# Altium schematic sheet FPGA_Config.SchDoc
size 420 x 297 mm
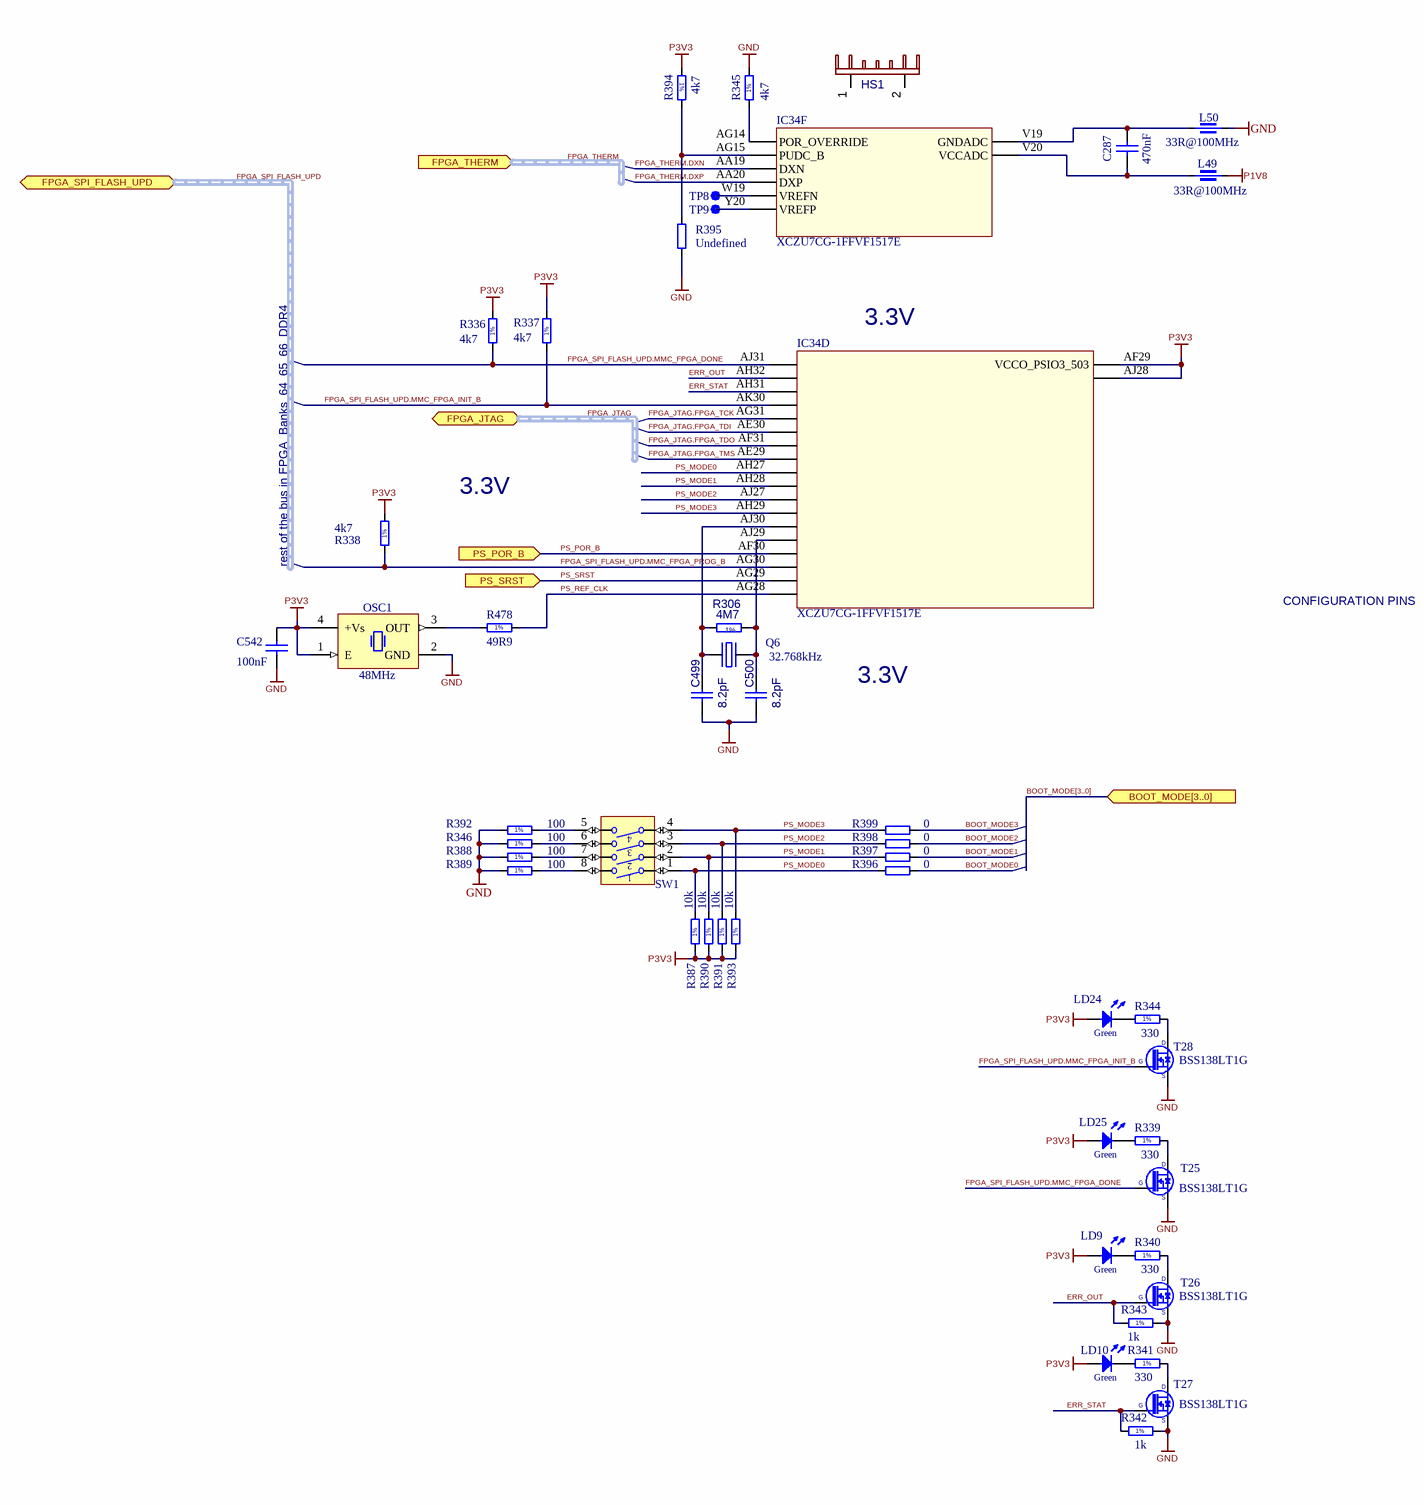
[diagram p0: FPGA_Config.SchDoc]

## Parts
C287  470nF  [CAPC0603X33N]
C499  value 8.2pF  [CAPC1005X55N]  (hidden comment: Capacitor - non polarized CAPC1005X55N)
C500  value 8.2pF  [CAPC1005X55N]  (hidden comment: Capacitor - non polarized CAPC1005X55N)
C542  100nF  [CAPC0603X33N]
HS1  HSINK_AAVID_342947  [HS_AAVID_342947]  (value not drawn)
IC34  XCZU7CG-1FFVF1517E  (parts D,F of 26)
L49  33R@100MHz  [INDC1005X55N]
L50  33R@100MHz  [INDC1005X55N]
LD9  Green  [LED_KINGBRIGHT_KPH-1608CGCK]
LD10  Green  [LED_KINGBRIGHT_KPH-1608CGCK]
LD24  Green  [LED_AVAGO_HSME-C120]
LD25  Green  [LED_AVAGO_HSME-C120]
OSC1  48MHz  [OSC_IQD_CFPS-39]
Q6  32.768kHz  [XTAL_ABRACON_ABS06]
R306  value 4M7  (hidden comment: Resistor - 1% RESC1005X40N)
R336  4k7  [RESC1005X40N]
R337  4k7  [RESC1005X40N]
R338  4k7  [RESC1005X40N]
R339  330  [RESC1005X40N]
R340  330  [RESC1005X40N]
R341  330  [RESC1005X40N]
R342  1k  [RESC1005X40N]
R343  1k  [RESC1005X40N]
R344  330  [RESC1005X40N]
R345  4k7  [RESC1005X40N]
R346  100  [RESC1005X40N]
R387  10k  [RESC1005X40N]
R388  100  [RESC1005X40N]
R389  100  [RESC1005X40N]
R390  10k  [RESC1005X40N]
R391  10k  [RESC1005X40N]
R392  100  [RESC1005X40N]
R393  10k  [RESC1005X40N]
R394  4k7  [RESC1005X40N]
R395  Undefined  [RESC1005X40N]
R396  0  [RESC1005X40N]
R397  0  [RESC1005X40N]
R398  0  [RESC1005X40N]
R399  0  [RESC1005X40N]
R478  49R9  [RESC1005X40N]
SW1  Switch  [SW_TYCO_1571983-4]  (value not drawn)
T25  BSS138LT1G  [SOT95P240X110-3N]
T26  BSS138LT1G  [SOT95P240X110-3N]
T27  BSS138LT1G  [SOT95P240X110-3N]
T28  BSS138LT1G  [SOT95P240X110-3N]
TP8  SMD Pad  [C100]  (value not drawn)
TP9  SMD Pad  [C100]  (value not drawn)

## Ports
BOOT_MODE[3..0] (in), FPGA_JTAG (bidir, harness FPGA_JTAG), FPGA_SPI_FLASH_UPD (bidir, harness FPGA_SPI_FLASH_UPD), FPGA_THERM (in, harness FPGA_THERM), PS_POR_B (in), PS_SRST (in)

## Nets
GND: C499.1 C500.1 C542.2 L50.1 OSC1.2(GND) R342.2 R343.2 R345.2 R346.1 R388.1 R389.1 R392.1 R395.1 T25.2(S) T26.2(S) T27.2(S) T28.2(S)
P1V8: L49.1
P3V3: C542.1 IC34.AF29(VCCO_PSIO3_503) IC34.AJ28(VCCO_PSIO3_503_1) LD9.2(A) LD10.2(A) LD24.2(A) LD25.2(A) OSC1.1(E) OSC1.4(+Vs) R336.2 R337.2 R338.2 R387.1 R390.1 R391.1 R393.1 R394.1
BOOT_MODE0: R396.2
BOOT_MODE1: R397.2
BOOT_MODE2: R398.2
BOOT_MODE3: R399.2
ERR_OUT: IC34.AH32(PS8_X0Y0_1) R343.1 T26.1(G)
ERR_STAT: IC34.AH31(PS8_X0Y0_2) R342.1 T27.1(G)
FPGA_JTAG.FPGA_TCK: IC34.AG31(PS8_X0Y0_4)
FPGA_JTAG.FPGA_TDI: IC34.AE30(PS8_X0Y0_5)
FPGA_JTAG.FPGA_TDO: IC34.AF31(PS8_X0Y0_6)
FPGA_JTAG.FPGA_TMS: IC34.AE29(PS8_X0Y0_7)
FPGA_SPI_FLASH_UPD.MMC_FPGA_DONE: IC34.AJ31(PS8_X0Y0) R336.1 T25.1(G)
FPGA_SPI_FLASH_UPD.MMC_FPGA_INIT_B: IC34.AK30(PS8_X0Y0_3) R337.1 T28.1(G)
FPGA_SPI_FLASH_UPD.MMC_FPGA_PROG_B: IC34.AG30(PS8_X0Y0_15) R338.1
FPGA_THERM.DXN: IC34.AA19(DXN)
FPGA_THERM.DXP: IC34.AA20(DXP)
PS_MODE0: IC34.AH27(PS8_X0Y0_8) R387.2 R396.1 SW1.1
PS_MODE1: IC34.AH28(PS8_X0Y0_9) R390.2 R397.1 SW1.2
PS_MODE2: IC34.AJ27(PS8_X0Y0_10) R391.2 R398.1 SW1.3
PS_MODE3: IC34.AH29(PS8_X0Y0_11) R393.2 R399.1 SW1.4
PS_POR_B: IC34.AF30(PS8_X0Y0_14) ; port PS_POR_B
PS_REF_CLK: IC34.AG28(PS8_X0Y0_17) R478.2
PS_SRST: IC34.AG29(PS8_X0Y0_16) ; port PS_SRST
NetC287_1: C287.1 IC34.V19(GNDADC) L50.2
NetC287_2: C287.2 IC34.V20(VCCADC) L49.2
NetC499_2: C499.2 IC34.AJ30(PS8_X0Y0_12) Q6.2(OSC2) R306.1
NetC500_2: C500.2 IC34.AJ29(PS8_X0Y0_13) Q6.1(OSC1) R306.2
NetIC34_AG14: IC34.AG14(POR_OVERRIDE) R345.1
NetIC34_AG15: IC34.AG15(PUDC_B) R394.2 R395.2
NetIC34_W19: IC34.W19(VREFN) TP8.1
NetIC34_Y20: IC34.Y20(VREFP) TP9.1
NetLD9_1: LD9.1(C) R340.1
NetLD10_1: LD10.1(C) R341.1
NetLD24_1: LD24.1(C) R344.1
NetLD25_1: LD25.1(C) R339.1
NetOSC1_3: OSC1.3(OUT) R478.1
NetR339_2: R339.2 T25.3(D)
NetR340_2: R340.2 T26.3(D)
NetR341_2: R341.2 T27.3(D)
NetR344_2: R344.2 T28.3(D)
NetR346_2: R346.2 SW1.6
NetR388_2: R388.2 SW1.7
NetR389_2: R389.2 SW1.8
NetR392_2: R392.2 SW1.5

Not connected (* = marked no-connect by the designer): HS1 1(MOUNT1) 2(MOUNT2)

## Buses and harness runs
bus BOOT_MODE[3..0] = port BOOT_MODE[3..0]
harness FPGA_JTAG = port FPGA_JTAG
harness FPGA_SPI_FLASH_UPD = port FPGA_SPI_FLASH_UPD
harness FPGA_THERM = port FPGA_THERM

## Notes on the sheet
- (near IC34) 3.3V
- 3.3V
- rest of the bus in FPGA_Banks_64_65_66_DDR4
- CONFIGURATION PINS
- Project/Equipment
- Document
- Designer
- Drawn by
- Check.by
- Copyright WUT ISE 2020.
  This documentation describes Open Hardware and is licensed under the CERN OHL v.1.2. You may redistribute and modify this documentation under the terms of the CERN OHL v.1.2. (http://ohwr.org/CERNOHL). This documentation is distributed WITHOUT ANY EXPRESS OR IMPLIED WARRANTY, INCLUDING OF MERCHANTABILITY, SATISFACTORY QUALITY AND FITNESS FOR A PARTICULAR PURPOSE. Please see the CERN OHL v.1.2 for applicable conditions.
- Contact
- File
- Last Mod.
- Print Date
- Sheet
- Size
- A3
- of
- Rev
- (in symbol R306) 1%
- (in symbol R0402_1K_1%_0.0625W_100PPM) 1%
- (in symbol R0402_4K7_1%_0.0625W_100PPM) 1%
- (in symbol R0402_10K_1%_0.0625W_100PPM) 1%
- (in symbol R0402_49R9_1%_0.0625W_100PPM) 1%
- (in symbol R0402_100R_1%_0.1W_100PPM) 1%
- (in symbol R0402_330R_1%_0.0625W_100PPM) 1%

## Library data of the parts
C287 = CC0201_470NF_4V_20%_X5R: Non-polarised capacitor; Manufacturer: GENERIC; Manufacturer1 Part Number: AMK063BJ474MP-F; Part Description: SMD Multilayer Chip Ceramic Capacitor; TC: X5R; Tolerance: ±20%; Voltage: 4V; Author: CERN DEM JLC; Case: 0201; Component Kind: Standard; Component Type: Standard; CreateDate: 27/05/2010; HelpURL: \\cern.ch\dfs\Applications\Altium\Datasheets\CC0201_X5R_TAIYO-YUDEN_STANDARD-CLASS2.pdf; LatestRevisionDate: 27/05/2010; Manufacturer Part Number: CC0201_470NF_4V_20%_X5R; Manufacturer1 ComponentHeight: 0.33mm; Manufacturer1 Example: TAIYO YUDEN; Mounted: Yes; Part Number: CC0201_470NF_4V_20%_X5R; Pin Count: 2; SMD: Yes; Socket: No; Status: Not Recommended; Value: 470nF; Sense: No
C499 = CAPC1005X55N: Capacitor - non polarized CAPC1005X55N 8.2pF; Manufacturer Part Number: CC0402_8.2PF_50V_0.5PF_C0G; Manufacturer: GENERIC; Part Description: SMD Multilayer Chip Ceramic Capacitor; CmpIndex: 286; DXDB_LIBNAME: Capacitors SMD; Ref Designator: C499; SymIndex: 331; Tolerance: ±0.5pF; Cell Name: CAPC1005X55N; Part Name: Capacitor - non polarized CAPC1005X55N; Part Number: Capacitor - non polarized CAPC1005X55N; Orientation: 1 = 1
C500 = CAPC1005X55N: Capacitor - non polarized CAPC1005X55N 8.2pF; Manufacturer Part Number: CC0402_8.2PF_50V_0.5PF_C0G; Manufacturer: GENERIC; Part Description: SMD Multilayer Chip Ceramic Capacitor; CmpIndex: 619; DXDB_LIBNAME: Capacitors SMD; Ref Designator: C500; SymIndex: 331; Tolerance: ±0.5pF; Cell Name: CAPC1005X55N; Part Name: Capacitor - non polarized CAPC1005X55N; Part Number: Capacitor - non polarized CAPC1005X55N; Orientation: 1 = 1
C542 = CC0201_100NF_6.3V_10%_X5R: Non-polarised capacitor; Manufacturer: GENERIC; Manufacturer1 Part Number: 02016D104KAT2A; Part Description: SMD Multilayer Chip Ceramic Capacitor; TC: X5R; Tolerance: ±10%; Voltage: 6.3V; Author: CERN DEM JLC; Case: 0201; Component Kind: Standard; Component Type: Standard; CreateDate: 03/12/2007; HelpURL: \\cern.ch\dfs\Applications\Altium\Datasheets\CC0201_X5R_AVX.pdf; LatestRevisionDate: 03/12/2007; Manufacturer Part Number: CC0201_100NF_6.3V_10%_X5R; Manufacturer1 ComponentHeight: 0.33mm; Manufacturer1 Example: AVX; Mounted: Yes; Part Number: CC0201_100NF_6.3V_10%_X5R; Pin Count: 2; SMD: Yes; Socket: No; Status: Not Recommended; Value: 100nF; Sense: No
HS1 = HS_AAVID_342947: HSINK_AAVID_342947   1.9K/W; Manufacturer Part Number: 342947; Manufacturer: Aavid Thermalloy; Part Description: COPPER HEATSINK 57.9X59X11MM; CmpIndex: 21; DXDB_LIBNAME: MISC_GK; Ref Designator: HS1; SymIndex: 1784; Cell Name: HS_AAVID_342947; Part Name: HSINK_AAVID_342947; Part Number: HSINK_AAVID_342947; Value: 1.9K/W; Orientation: 0 = 0
L49 L50 = IND0402_MURATA_BLM15PX330SN1D: Manufacturer: MURATA; Part Description: SMD EMIFIL Chip Ferrite Bead; Tolerance: ±25%; Power: 3A; Resistance: 0.022R; Manufacturer Part Number: BLM15PX330SN1D; Part Number: IND0402_MURATA_BLM15PX330SN1D; Value: 33R@100MHz; Component Kind: Standard; Component Type: Standard; Pin Count: 2; Status: None; Case: 0402; Mounted: Yes; Socket: No; SMD: Yes; Sense: No; ComponentHeight: 0.55mm; HelpURL: \\cern.ch\dfs\Applications\Altium\Datasheets\IND0402_MURATA_BLM15PX.pdf; Author: CERN DEM JMW; CreateDate: 19/02/2014; LatestRevisionDate: 25/10/2018
LD9 LD10 = LED_KINGBRIGHT_KPH-1608CGCK: LED Green 1C 2A; Part Description: SMD Green LED, Case 1.6mmX0.8mm(0603), 0.65mm Thickness; PressFit: No; Bonding: No; Manufacturer Part Number: KPH-1608CGCK; Manufacturer: KINGBRIGHT; PackageDescription: SMT Green LED, Case 0603, Body L 1.6 x W 0.8mm H 0.65mm; Part Number: LED_KINGBRIGHT_KPH-1608CGCK; Component Kind: Standard; Component Type: Standard; Color: Green; Pin Count: 2; Mounted: Yes; Socket: No; SMD: Yes; Sense: No; ComponentHeight: 0.65mm; HelpURL: \\cern.ch\dfs\Applications\Altium\Datasheets\LED_KINGBRIGHT_KPH-1608CGCK.pdf; Author: CERN DEM JLC; CreateDate: 03.07.2017; LatestRevisionDate: 03.07.2017
LD24 LD25 = LED_AVAGO_HSME-C120: LED Green 1C 2A; Manufacturer: AVAGO TECHNOLOGIES; Part Description: High Performance Right Angle Chip Green LED; PressFit: No; Bonding: No; Manufacturer Part Number: HSME-C120; PackageDescription: Green Chip LED, 2-Leads, Body 1.7x1.1mm, Side Emitting Package; Part Number: LED_AVAGO_HSME-C120; Component Kind: Standard; Component Type: Standard; Color: Green; Pin Count: 2; Mounted: Yes; Socket: No; SMD: Yes; Sense: No; ComponentHeight: 0.7mm; HelpURL: \\cern.ch\dfs\Applications\Altium\Datasheets\LED_AVAGO_HSME-C120.pdf; ComponentLink1URL: \\cern.ch\dfs\Applications\Altium\Datasheets\LED_AVAGO_HSME-C110_DESIGN-GUIDE.pdf; ComponentLink1Description: Design Guide; Author: CERN DEM JMW; CreateDate: 22.07.2009; LatestRevisionDate: 20.06.2012
OSC1 = OSC_48MHZ_IQD_LFSPXO025166: Oscillator 4 pins 1=E 2=GND 3=OUT 4=+Vs; Manufacturer: IQD FREQUENCY PRODUCTS; Part Description: 3.3V, ±50ppm, 15pF, -40..85°C, CMOS Surface Mount Clock Oscillator (CFPS-39 Series); PressFit: No; Bonding: No; Manufacturer Part Number: LFSPXO025166; PackageDescription: Oscillator, Corner Concave, 2.20mm Pitch, 4 Pins, 2.70mm L X 3.40mm W X 1.20mm H, CFPS-39 Series; Part Number: OSC_48MHZ_IQD_LFSPXO025166; Value: 48MHz; Component Kind: Standard; Component Type: Standard; Pin Count: 4; Mounted: Yes; Socket: No; SMD: Yes; Sense: No; ComponentHeight: 1.2mm; HelpURL: \\cern.ch\dfs\Applications\Altium\Datasheets\OSC_IQD_LFSPXO025166.pdf; Author: CERN DEM JLC; CreateDate: 23.03.2011; LatestRevisionDate: 03.11.2016
Q6 = XTAL_32.768KHZ_ABRACON_ABS06-32.768KHZ-9: Quartz Crystal; Part Description: Tolerance: ±20ppm, -40°C to +85°C, 9pF, SMD Low Profile Crystal, ABS06 Series; PressFit: No; Bonding: No; Manufacturer Part Number: ABS06-32.768kHz-9; Manufacturer: ABRACON; PackageDescription: 2 Pins, 2.15x1.3mm, SMD Low Profile Crystal, ABS06 Series; Part Number: XTAL_32.768KHZ_ABRACON_ABS06-32.768KHZ-9; Value: 32.768kHz; Component Kind: Standard; Component Type: Standard; Pin Count: 2; Mounted: Yes; Socket: No; SMD: Yes; Sense: No; ComponentHeight: 0.6mm; HelpURL: \\cern.ch\dfs\Applications\Altium\Datasheets\XTAL_ABRACON_ABS06.pdf; Author: CERN DEM JMW; CreateDate: 12/08/2015; LatestRevisionDate: 12/08/2015
R306 = (no symbol name): Resistor - 1% RESC1005X40N 4M7; Manufacturer Part Number: R0402_4M7_1%_0.0625W_100PPM; Manufacturer: GENERIC; Part Description: General Purpose Thick Film Chip Resistor; CmpIndex: 616; DXDB_LIBNAME: Resistors SMD; Ref Designator: R306; SymIndex: 317; Cell Name: RESC1005X40N; Part Name: Resistor - 1% RESC1005X40N; Part Number: Resistor - 1% RESC1005X40N; Tolerance: ±1%; Orientation: 0 = 0
R336-R338 R345 R394 = R0402_4K7_1%_0.0625W_100PPM: Resistor - 1%; Manufacturer: GENERIC; Part Description: General Purpose Thick Film Chip Resistor; Manufacturer1 Part Number: 232270674702L; TC: ±100ppm/°C; PressFit: No; Manufacturer Part Number: R0402_4K7_1%_0.0625W_100PPM; Part Number: R0402_4K7_1%_0.0625W_100PPM; Tolerance: ±1%; Value: 4k7; Component Kind: Standard; Component Type: Standard; Pin Count: 2; Status: Not Recommended; Power: 0.0625W; Case: 0402; Mounted: Yes; Sense: No; Socket: No; SMD: Yes; Manufacturer1 Example: YAGEO PHYCOMP; Manufacturer1 ComponentHeight: 0.4mm; HelpURL: \\cern.ch\dfs\Applications\Altium\Datasheets\R0402_Phycomp_RC0402.pdf; Author: CERN DEM JLC; CreateDate: 03/12/2007; LatestRevisionDate: 17/10/2012
R339-R341 R344 = R0402_330R_1%_0.0625W_100PPM: Resistor - 1%; Manufacturer: GENERIC; Part Description: General Purpose Thick Film Chip Resistor; Manufacturer1 Part Number: 232270673301L; TC: ±100ppm/°C; PressFit: No; Manufacturer Part Number: R0402_330R_1%_0.0625W_100PPM; Part Number: R0402_330R_1%_0.0625W_100PPM; Tolerance: ±1%; Value: 330; Component Kind: Standard; Component Type: Standard; Pin Count: 2; Status: Not Recommended; Power: 0.0625W; Case: 0402; Mounted: Yes; Sense: No; Socket: No; SMD: Yes; Manufacturer1 Example: YAGEO PHYCOMP; Manufacturer1 ComponentHeight: 0.4mm; HelpURL: \\cern.ch\dfs\Applications\Altium\Datasheets\R0402_Phycomp_RC0402.pdf; Author: CERN DEM JLC; CreateDate: 03/12/2007; LatestRevisionDate: 17/10/2012
R342 R343 = R0402_1K_1%_0.0625W_100PPM: Resistor - 1%; Manufacturer: GENERIC; Part Description: General Purpose Thick Film Chip Resistor; Manufacturer1 Part Number: 232270671002L; TC: ±100ppm/°C; PressFit: No; Manufacturer Part Number: R0402_1K_1%_0.0625W_100PPM; Part Number: R0402_1K_1%_0.0625W_100PPM; Tolerance: ±1%; Value: 1k; Component Kind: Standard; Component Type: Standard; Pin Count: 2; Status: Not Recommended; Power: 0.0625W; Case: 0402; Mounted: Yes; Sense: No; Socket: No; SMD: Yes; Manufacturer1 Example: YAGEO PHYCOMP; Manufacturer1 ComponentHeight: 0.4mm; HelpURL: \\cern.ch\dfs\Applications\Altium\Datasheets\R0402_Phycomp_RC0402.pdf; Author: CERN DEM JLC; CreateDate: 03/12/2007; LatestRevisionDate: 17/10/2012
R346 R388 R389 R392 = R0402_100R_1%_0.1W_100PPM: Resistor - 1%; Manufacturer Part Number: R0402_100R_1%_0.1W_100PPM_50V; Manufacturer: GENERIC; Part Description: General Purpose Thick Film Chip Resistor; Manufacturer1 Part Number: ERJ2RKF1000X; Power: 0.1W; TC: ±100ppm/°C; Voltage: 50V; PressFit: No; Part Number: R0402_100R_1%_0.1W_100PPM; Tolerance: ±1%; Value: 100; Component Kind: Standard; Component Type: Standard; Pin Count: 2; Status: Not Recommended; Case: 0402; Mounted: Yes; Sense: No; Socket: No; SMD: Yes; Manufacturer1 Example: PANASONIC; Manufacturer1 ComponentHeight: 0.4mm; HelpURL: \\cern.ch\dfs\Applications\Altium\Datasheets\R0402_PANASONIC_ERJ2RK.pdf; Author: CERN DEM JLC; CreateDate: 12/12/2013; LatestRevisionDate: 03/03/2015
R387 R390 R391 R393 = R0402_10K_1%_0.0625W_100PPM: Resistor - 1%; Manufacturer: GENERIC; Part Description: General Purpose Thick Film Chip Resistor; Manufacturer1 Part Number: 232270671003L; TC: ±100ppm/°C; PressFit: No; Manufacturer Part Number: R0402_10K_1%_0.0625W_100PPM; Part Number: R0402_10K_1%_0.0625W_100PPM; Tolerance: ±1%; Value: 10k; Component Kind: Standard; Component Type: Standard; Pin Count: 2; Status: Not Recommended; Power: 0.0625W; Case: 0402; Mounted: Yes; Sense: No; Socket: No; SMD: Yes; Manufacturer1 Example: YAGEO PHYCOMP; Manufacturer1 ComponentHeight: 0.4mm; HelpURL: \\cern.ch\dfs\Applications\Altium\Datasheets\R0402_Phycomp_RC0402.pdf; Author: CERN DEM JLC; CreateDate: 03/12/2007; LatestRevisionDate: 17/10/2012
R395 = R0402_NO-VALUE: Resistor; Part Description: Reserved Footprint For a 0402 (1005) Chip Resistor; PressFit: No; Mounted: No; Manufacturer Part Number: R0402_NO-VALUE; Manufacturer: Undefined; Part Number: R0402_NO-VALUE; Value: Undefined; Component Kind: Standard; Component Type: Standard; Pin Count: 2; Status: None; Case: 0402; Sense: No; Socket: No; SMD: Yes; Manufacturer1 Example: Undefined; Manufacturer1 Part Number: Undefined; Manufacturer1 ComponentHeight: Undefined; HelpURL: Undefined; Author: CERN DEM JLC; CreateDate: 03/12/2007; LatestRevisionDate: 13/03/2008
R396-R399 = R0402_0R_JUMPER: Resistor; Manufacturer: GENERIC; Part Description: 1A (0.05R Max DC Resistance) Zero Ohm Jumper; Manufacturer1 Part Number: 232270591001L; PressFit: No; Manufacturer Part Number: R0402_0R_JUMPER; Part Number: R0402_0R_JUMPER; Value: 0; Component Kind: Standard; Component Type: Standard; Pin Count: 2; Status: Not Recommended; Case: 0402; Mounted: Yes; Sense: No; Socket: No; SMD: Yes; Manufacturer1 Example: YAGEO PHYCOMP; Manufacturer1 ComponentHeight: 0.4mm; HelpURL: \\cern.ch\dfs\Applications\Altium\Datasheets\R0402_Phycomp_RC0402.pdf; Author: CERN DEM JLC; CreateDate: 03/12/2007; LatestRevisionDate: 17/10/2012
R478 = R0402_49R9_1%_0.0625W_100PPM: Resistor - 1%; Manufacturer: GENERIC; Part Description: General Purpose Thick Film Chip Resistor; Manufacturer1 Part Number: 232270674999L or RC0402FR-0749R9L; TC: ±100ppm/°C; PressFit: No; Manufacturer Part Number: R0402_49R9_1%_0.0625W_100PPM; Part Number: R0402_49R9_1%_0.0625W_100PPM; Tolerance: ±1%; Value: 49R9; Component Kind: Standard; Component Type: Standard; Pin Count: 2; Status: Not Recommended; Power: 0.0625W; Case: 0402; Mounted: Yes; Sense: No; Socket: No; SMD: Yes; Manufacturer1 Example: YAGEO PHYCOMP; Manufacturer1 ComponentHeight: 0.4mm; HelpURL: \\cern.ch\dfs\Applications\Altium\Datasheets\R0402_Phycomp_RC0402.pdf; Author: CERN DEM JLC; CreateDate: 24/10/2012; LatestRevisionDate: 24/10/2012
SW1 = SW_TYCO_1571983-4: 4 Ways SPST DIP Switch; Manufacturer Part Number: 1571983-4 or GDH04S04; Manufacturer: TYCO; Part Description: 4 Way SPST SMD DIP Switch, Latched, Contact Rating 0.025A 24VDC; PressFit: No; PackageDescription: Pitch 1.27mm,  Body 6.2x6.2mm, 4 Ways SPST Surface-Mount DIP Switch, TYCO GDH Series; Part Number: SW_TYCO_1571983-4; Component Kind: Standard; Component Type: Standard; Pin Count: 8; Family: Switch; Mounted: Yes; Socket: No; SMD: Yes; Sense: No; Status: None; ComponentHeight: 2.31mm; HelpURL: \\cern.ch\dfs\Applications\Altium\Datasheets\SW_TYCO_1571983-4.pdf; Author: CERN DEM JLC; CreateDate: 08.01.2009; LatestRevisionDate: 08.01.2009
T25-T28 = BSS138LT1G: N-CHANNEL MOSFET WITH DIODE; Manufacturer: ON SEMICONDUCTOR; Part Description: 50V 200mA N-Channel Enhancement Mode Field-Effect Transistor; PressFit: No; Bonding: No; Manufacturer Part Number: BSS138LT1G; PackageDescription: SOT23 3-Leads, Pitch 0.95mm - Body 1.4x3mm, IPC Medium Density; Part Number: BSS138LT1G; Component Kind: Standard; Component Type: Standard; Device: BSS138LT1G; Pin Count: 3; Case: SOT23-3; Mounted: Yes; Socket: No; SMD: Yes; Sense: No; ComponentHeight: 1.11mm; HelpURL: \\cern.ch\dfs\Applications\Altium\Datasheets\BSS138LT1G.pdf; Author: CERN DEM JLC; CreateDate: 23.03.2009; LatestRevisionDate: 23.03.2009
TP8 TP9 = SMD_PAD_D1MM: Through Hole Pad; Part Description: 1mm Diameter SMD Pad; Mounted: No; PackageDescription: 1mm Diameter SMD Pad; Part Number: SMD_PAD_D1MM; Component Kind: Standard (No BOM); Component Type: Standard (No BOM); Pin Count: 1; Family: SMD Pad; Socket: No; SMD: No; Sense: No; Status: None; ComponentHeight: 0mm; HelpURL: Undefined; Author: CERN DEM JLC; CreateDate: 10/10/2017; LatestRevisionDate: 10/10/2017